# EasyEDA Pro project ProProject_IMUSensorNodes202312.epro, board 6_6_拼板20240123（不带编号） (continued)
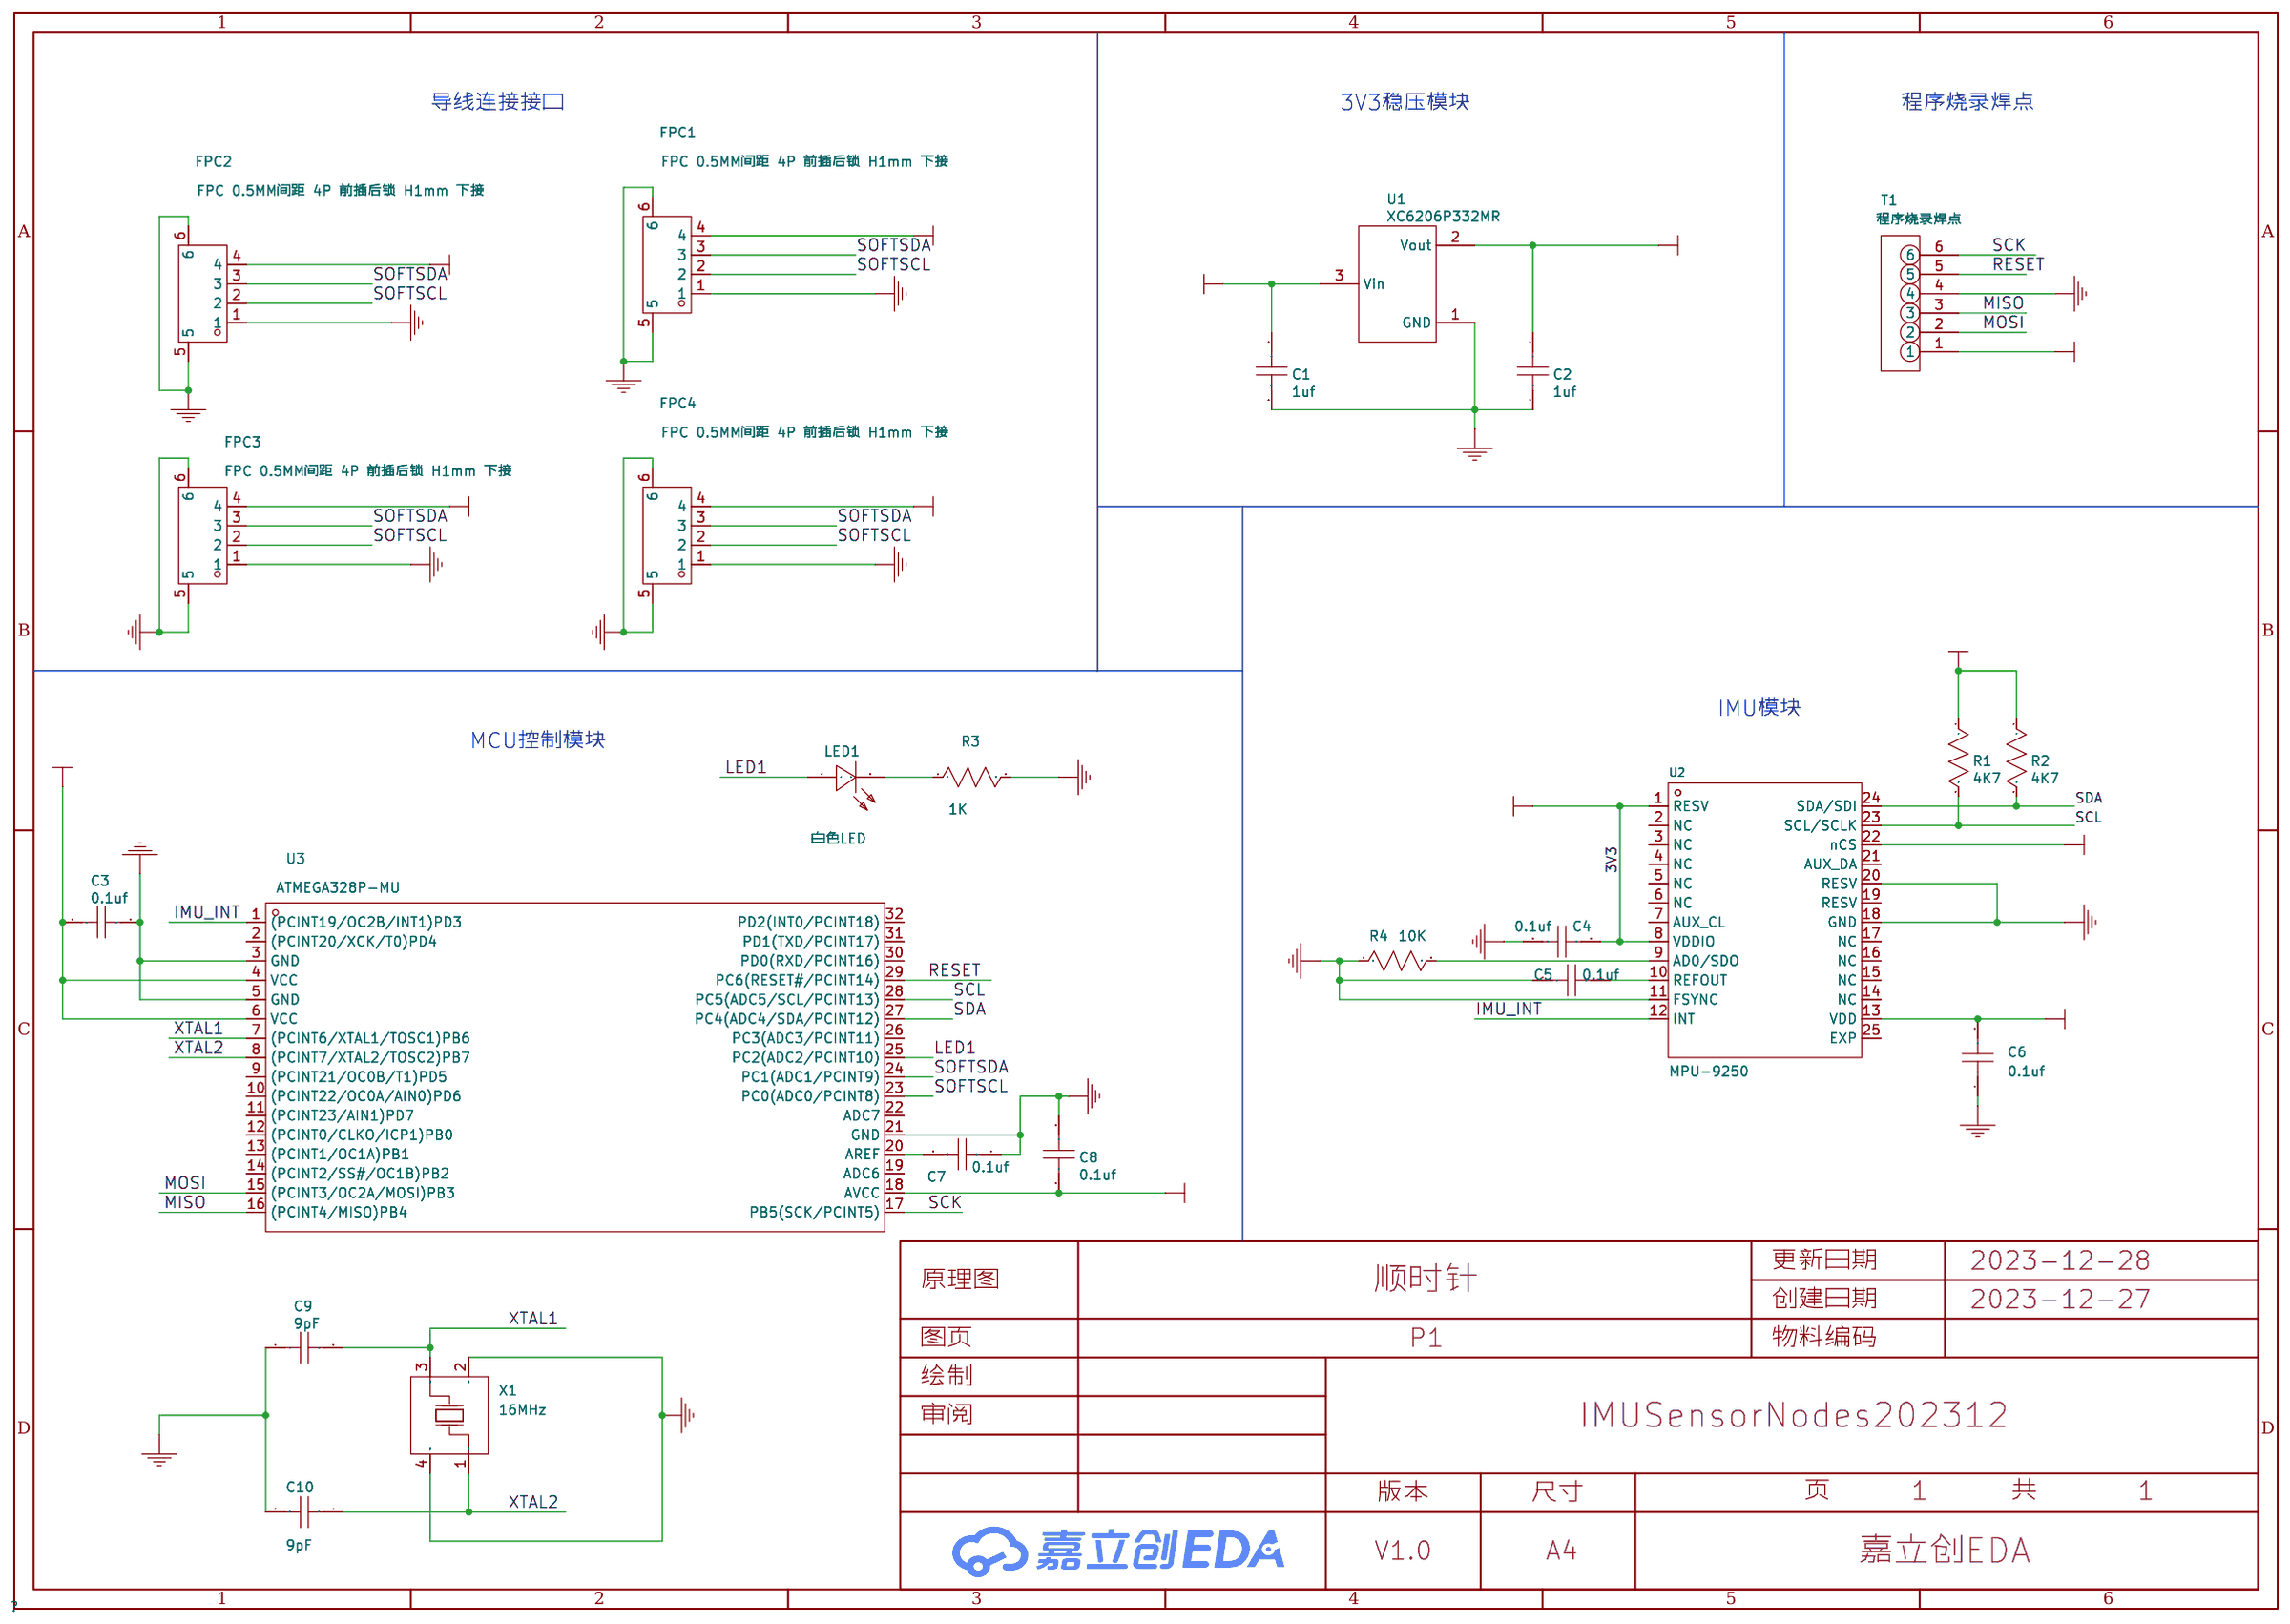
[diagram p0: schematic sheet]
## Routing (per net, layer and track width the routed paths; a pad name or vN(x,y) marks a point on that pad's centre or on a via; arc(x,y) is an arc through that point) (continued)
  Bottom Layer w0.254: v1(75.22,69.75) 74.83,69.37 74.18,69.37 73.92,69.62 U3#83.18 ; 28.31,51.84 28.57,52.1 28.61,52.1 ; 28.31,51.84 28.35,51.84 28.61,52.1 ; 28.31,51.84 v1(28.22,51.84) ; U2#15.8 60.74,78.7 60.74,79.66 ; C4#5.1 48.77,38.85 48.73,38.89 ; C4#5.1 arc(48.92,38.74) 49.28,38.89 ; C4#5.1 arc(48.62,38.74) 48.27,38.89 ; C2#30.1 9.94,46.66 9.94,47.4 ; R2#6.1 70.11,79.63 v1(70.52,80.04) 71.32,80.04 ; 55.91,79.53 R2#20.1 56.14,79.76 ; 55.91,79.53 55.87,79.53 55.62,79.28 ; 55.91,79.53 56.14,79.76 ; 55.91,79.53 55.66,79.28 55.62,79.28 ; 21.98,11.46 23.91,11.46 24.29,11.08 24.29,9.43 23.27,8.41 23.27,5.49 23.4,5.36 23.63,5.36 C2#14.1 ; 21.98,11.46 21.43,11.46 ; 21.98,11.46 arc(21.62,11.31) C4#16.1 ; 6.13,52.23 6.13,51.27 U2#30.8 ; 19.78,52.58 19.78,52.11 arc(19.64,52.46) 19.29,52.61 ; 64.55,19.97 64.55,22.38 65.18,23.02 65.18,24.41 64.42,25.17 62.74,25.17 ; 64.55,19.97 64.87,20.29 65.43,20.29 ; 64.55,19.97 64.55,19.23 C2#11.1 ; 1.3,65.81 1.53,66.04 ; 1.3,65.81 1.26,65.81 1.01,65.56 ; 1.3,65.81 R2#24.1 1.53,66.04 ; 1.3,65.81 1.05,65.56 1.01,65.56 ; 1.53,66.04 1.81,66.32 ; 17.32,52.21 U2#14.1 arc(17.14,52.43) 16.71,52.61 ; 17.32,52.21 17.32,52.61 ; 17.32,52.21 arc(17.44,52.49) 17.72,52.61 ; U2#35.22 71.12,23.34 70.77,22.99 v1(70.77,22.64) 70.8,22.61 C3#12.1 70.8,20.98 73.31,20.98 73.44,20.86 ; U1#35.2 78.36,46.94 C2#35.1 ; 9.94,61.12 9.94,60.38 C2#24.1 ; 9.94,61.12 9.94,63.53 10.57,64.16 10.57,65.56 9.81,66.32 8.13,66.32 ; 9.94,61.12 10.26,61.44 10.82,61.44 ; 17.32,79.64 U2#7.1 arc(17.14,79.86) 16.71,80.04 ; 17.32,79.64 17.32,80.04 ; 17.32,79.64 arc(17.44,79.92) 17.72,80.04 ; 1.3,10.95 R2#13.1 1.53,11.18 ; 1.3,10.95 1.53,11.18 ; 1.3,10.95 1.05,10.7 1.01,10.7 ; 1.3,10.95 1.26,10.95 1.01,10.7 ; U3#85.6 59.72,6.39 v2(59.72,7.33) 59.78,7.4 60.1,7.4 60.21,7.51 U2#23.13 ; R2#31.1 15.5,52.2 v1(15.91,52.61) 16.71,52.61 ; C4#3.1 21.47,38.85 21.43,38.89 ; C4#3.1 arc(21.62,38.74) 21.98,38.89 ; C4#3.1 arc(21.32,38.74) 20.96,38.89 ; 18.83,75.72 18.7,75.85 16.19,75.85 C3#21.1 16.19,77.47 v1(16.16,77.5) 16.16,77.86 16.51,78.21 16.89,78.21 ; 20.04,38.87 20.01,38.89 ; 20.01,38.89 19.29,38.89 ; 20.01,38.89 20.38,38.89 ; C4#12.1 62.24,80.01 62.26,80.04 62.74,80.04 ; C4#12.1 arc(62.09,79.89) 61.73,80.04 61.5,80.04 ; C4#12.1 arc(62.38,79.89) 62.74,80.04 ; C2#16.1 50.93,5.36 50.7,5.36 50.58,5.49 50.58,8.41 51.59,9.43 51.59,11.08 51.21,11.46 49.28,11.46 ; C2#16.1 51.06,4.22 50.68,3.84 v1(49.69,3.84) C8#16.1 ; C2#16.1 51.06,5.79 U1#16.2 ; 37.24,47.4 37.24,46.66 C2#32.1 ; 37.24,47.4 37.56,47.72 38.12,47.72 ; 37.24,47.4 37.24,49.81 37.88,50.45 37.88,51.84 37.12,52.61 35.44,52.61 ; v1(28.22,65.56) 28.31,65.56 ; 28.31,65.56 28.35,65.56 28.61,65.81 ; 28.31,65.56 28.57,65.81 28.61,65.81 ; C8#29.1 v1(76.99,58.7) 77.98,58.7 78.36,59.08 C2#29.1 ; 9.94,33.68 9.94,32.95 C2#36.1 ; 9.94,33.68 10.26,34 10.82,34 ; 9.94,33.68 9.94,36.1 10.57,36.73 10.57,38.13 9.81,38.89 8.13,38.89 ; C8#12.1 v1(76.99,17.56) 77.98,17.56 78.36,17.94 C2#12.1 ; 65.43,6.57 64.87,6.57 64.55,6.25 ; 65.43,75.15 64.87,75.15 64.55,74.83 ; C4#30.1 76.08,66.28 76.04,66.32 ; C4#30.1 arc(75.93,66.17) 75.57,66.32 ; C4#30.1 arc(76.23,66.17) 76.59,66.32 ; 16.71,80.04 17.72,80.04 ; 16.71,80.04 v1(15.91,80.04) 15.5,79.63 R2#21.1 ; 17.72,80.04 19.29,80.04 ; 48.27,38.89 48.73,38.89 ; 48.27,38.89 47.69,38.89 ; 48.73,38.89 49.28,38.89 ; 76.04,66.32 76.59,66.32 ; 76.04,66.32 75.57,66.32 ; 47.69,38.89 47.32,38.89 ; 47.69,38.89 arc(47.26,38.71) 47.09,38.29 ; 37.24,74.83 37.56,75.15 38.12,75.15 ; 37.24,74.83 37.24,77.25 37.88,77.88 37.88,79.28 37.12,80.04 35.44,80.04 ; 37.24,74.83 37.24,74.09 C2#22.1 ; 21.43,38.89 21.98,38.89 ; 21.43,38.89 20.96,38.89 ; 21.98,38.89 23.91,38.89 24.29,38.51 24.29,36.86 23.27,35.84 23.27,32.92 23.4,32.8 23.63,32.8 C2.1 ; 65.43,47.72 64.87,47.72 64.55,47.4 ; 75.57,25.17 76.04,25.17 ; 75.57,25.17 74.99,25.17 ; 75.57,25.17 arc(75.93,25.03) C4.1 ; 76.04,25.17 76.08,25.14 C4.1 ; 76.04,25.17 76.59,25.17 ; R1#2.1 28.45,36.86 v1(28.35,36.86) ; v1(75.22,56.04) 74.83,55.66 74.18,55.66 73.92,55.91 U3#61.18 ; 55.62,38.13 55.87,38.38 55.91,38.38 ; 55.62,38.13 v1(55.53,38.13) ; 55.62,38.13 55.66,38.13 55.91,38.38 ; 71.93,11.06 U2#20.1 arc(71.75,11.28) 71.32,11.46 ; 71.93,11.06 71.93,11.46 ; 71.93,11.06 arc(72.05,11.34) 72.32,11.46 ; v1(14.94,64.29) 14.94,64.34 15.27,64.67 R1#25.1 ; C8#10.1 v1(49.69,17.56) 50.68,17.56 51.06,17.94 C2#10.1 ; 46.13,7.14 46,7.27 43.49,7.27 C3#16.1 43.49,8.89 v1(43.47,8.92) 43.47,9.28 43.82,9.63 U2#19.22 ; 18.83,48.29 18.7,48.42 16.19,48.42 C3#31.1 16.19,50.04 v1(16.16,50.07) 16.16,50.42 16.51,50.78 U2#14.22 ; 48.27,25.17 47.69,25.17 ; 48.27,25.17 48.73,25.17 ; 48.27,25.17 arc(48.62,25.03) C4#13.1 ; 47.69,25.17 47.32,25.17 ; 47.69,25.17 arc(47.26,25) 47.09,24.57 ; 76.59,52.61 78.52,52.61 78.9,52.23 78.9,50.58 77.88,49.56 77.88,46.64 78.01,46.51 78.24,46.51 C2#35.1 ; 76.59,52.61 76.04,52.61 ; 76.59,52.61 arc(76.23,52.46) C4#36.1 ; 48.27,66.32 47.69,66.32 ; 48.27,66.32 48.73,66.32 ; 48.27,66.32 arc(48.62,66.17) C4#28.1 ; 47.69,66.32 47.32,66.32 ; 47.69,66.32 arc(47.26,66.15) 47.09,65.72 ; 72.32,52.61 73.9,52.61 ; 72.32,52.61 71.32,52.61 ; 72.32,52.61 arc(72.05,52.49) 71.93,52.21 ; 73.9,52.61 74.62,52.61 ; 73.9,52.61 arc(74.25,52.46) 74.39,52.11 74.39,52.58 ; 76.59,66.32 78.52,66.32 78.9,65.94 78.9,64.29 77.88,63.28 77.88,60.35 78.01,60.23 78.24,60.23 C2#29.1 ; 20.04,80.02 20.01,80.04 ; 20.01,80.04 20.38,80.04 ; 20.01,80.04 19.29,80.04 ; 17.32,38.5 17.32,38.89 ; 17.32,38.5 U2#28.1 arc(17.14,38.71) 16.71,38.89 ; 17.32,38.5 arc(17.44,38.78) 17.72,38.89 ; C2#10.1 51.06,19.51 U1#10.2 ; C2#10.1 50.93,19.08 50.7,19.08 50.58,19.21 50.58,22.13 51.59,23.14 51.59,24.79 51.21,25.17 49.28,25.17 ; 47.32,11.46 47.69,11.46 ; 47.32,11.46 46.59,11.46 ; 47.32,11.46 47.34,11.44 ; 47.69,11.46 48.27,11.46 ; 47.69,11.46 arc(47.26,11.28) 47.09,10.86 ; 21.98,52.61 23.91,52.61 24.29,52.23 24.29,50.58 23.27,49.56 23.27,46.64 23.4,46.51 23.63,46.51 C2#31.1 ; 21.98,52.61 21.43,52.61 ; 21.98,52.61 arc(21.62,52.46) C4#32.1 ; 28.83,11.18 29.11,11.46 ; 28.83,11.18 28.61,10.95 ; 28.83,11.18 R2#15.1 28.61,10.95 ; U3#95.18 19.31,14.76 19.57,14.51 20.22,14.51 v1(20.6,14.89) ; 28.61,65.81 28.83,66.04 ; 28.61,65.81 R2#26.1 28.83,66.04 ; 28.83,66.04 29.11,66.32 ; C2#6.1 78.24,73.94 78.01,73.94 77.88,74.07 77.88,76.99 78.9,78.01 78.9,79.66 78.52,80.04 76.59,80.04 ; C2#6.1 78.36,74.37 U1#6.2 ; C2#6.1 78.36,72.8 77.98,72.42 v1(76.99,72.42) C8#6.1 ; v1(55.53,10.7) 55.62,10.7 ; 55.62,10.7 55.66,10.7 55.91,10.95 ; 55.62,10.7 55.87,10.95 55.91,10.95 ; 33.43,79.66 33.43,78.7 U2#27.8 ; C2#21.1 23.75,74.37 U1#21.2 ; C2#21.1 23.63,73.94 23.4,73.94 23.27,74.07 23.27,76.99 24.29,78.01 24.29,79.66 23.91,80.04 21.98,80.04 ; C2#21.1 23.75,72.8 23.37,72.42 v1(22.38,72.42) C8#21.1 ; 1.01,51.84 1.26,52.1 1.3,52.1 ; 1.01,51.84 1.05,51.84 1.3,52.1 ; 1.01,51.84 v1(0.92,51.84) ; R1#24.1 1.15,64.29 v1(1.05,64.29) ; 71.93,52.21 U2#6.1 arc(71.75,52.43) 71.32,52.61 ; 71.93,52.21 71.93,52.61 ; 74.99,25.17 74.62,25.17 ; 74.99,25.17 arc(74.57,25) 74.39,24.57 ; 48.27,11.46 48.73,11.46 ; 48.27,11.46 arc(48.62,11.31) C4#18.1 ; 48.73,11.46 48.77,11.42 C4#18.1 ; 48.73,11.46 49.28,11.46 ; v1(14.94,23.14) 14.94,23.19 15.27,23.52 R1#8.1 ; 28.31,10.7 28.35,10.7 28.61,10.95 ; 28.31,10.7 28.57,10.95 28.61,10.95 ; 28.31,10.7 v1(28.22,10.7) ; 8.13,66.32 7.65,66.32 7.63,66.3 C4#25.1 ; 8.13,66.32 arc(7.77,66.17) C4#25.1 ; 44.02,66.32 v1(43.21,66.32) 42.8,65.92 R2#27.1 ; 44.02,66.32 45.02,66.32 ; 44.02,66.32 arc(44.45,66.15) U2#34.1 44.62,65.93 ; v1(14.94,36.86) 14.94,36.91 15.27,37.24 R1.1 ; 75.57,66.32 74.99,66.32 ; 28.61,79.53 28.57,79.53 28.31,79.28 ; 28.61,79.53 28.35,79.28 28.31,79.28 ; 28.61,79.53 28.83,79.76 ; 28.61,79.53 R2#22.1 28.83,79.76 ; U1#8.2 23.75,19.51 C2#8.1 ; 28.61,38.38 R2#2.1 28.83,38.61 ; 28.61,38.38 28.35,38.13 28.31,38.13 ; 28.61,38.38 28.57,38.38 28.31,38.13 ; 28.61,38.38 28.83,38.61 ; C2#5.1 78.36,31.65 77.98,31.27 v1(76.99,31.27) C8#5.1 ; C2#5.1 78.24,32.8 78.01,32.8 77.88,32.92 77.88,35.84 78.9,36.86 78.9,38.51 78.52,38.89 76.59,38.89 ; C2#5.1 78.36,33.22 U1#5.2 ; 72.32,66.32 73.9,66.32 ; 72.32,66.32 71.32,66.32 ; 72.32,66.32 arc(72.05,66.21) 71.93,65.93 ; 73.9,66.32 74.62,66.32 ; 73.9,66.32 arc(74.25,66.18) 74.39,65.83 74.39,66.3 ; C2#33.1 51.06,45.37 50.68,44.99 v1(49.69,44.99) C8#33.1 ; C2#33.1 51.06,46.94 U1#33.2 ; C2#33.1 50.93,46.51 50.7,46.51 50.58,46.64 50.58,49.56 51.59,50.58 51.59,52.23 51.21,52.61 49.28,52.61 ; v1(55.53,65.56) 55.62,65.56 ; 55.62,65.56 55.87,65.81 55.91,65.81 ; 55.62,65.56 55.66,65.56 55.91,65.81 ; 55.91,24.67 R2#11.1 56.14,24.9 ; 55.91,24.67 55.66,24.41 55.62,24.41 ; 55.91,24.67 55.87,24.67 55.62,24.41 ; 55.91,24.67 56.14,24.9 ; 55.91,10.95 R2#17.1 56.14,11.18 ; 55.91,10.95 56.14,11.18 ; C2#15.1 37.24,5.51 37.24,6.25 ; 75.57,80.04 76.04,80.04 ; 75.57,80.04 74.99,80.04 ; 75.57,80.04 arc(75.93,79.89) C4#8.1 ; 76.04,80.04 76.08,80 C4#8.1 ; 76.04,80.04 76.59,80.04 ; C8#31.1 v1(22.38,44.99) 23.37,44.99 23.75,45.37 C2#31.1 ; U2#28.22 16.51,37.06 16.16,36.71 v1(16.16,36.35) 16.19,36.33 C3.1 16.19,34.7 18.7,34.7 18.83,34.57 ; 1.01,24.41 1.26,24.67 1.3,24.67 ; 1.01,24.41 1.05,24.41 1.3,24.67 ; 1.01,24.41 v1(0.92,24.41) ; 46.13,48.29 46,48.42 43.49,48.42 C3#33.1 43.49,50.04 v1(43.47,50.07) 43.47,50.42 43.82,50.78 U2#5.22 ; 34.19,66.32 34.42,66.32 arc(34.78,66.17) C4#27.1 ; U3#66.6 59.72,74.97 v2(59.72,75.91) 59.78,75.97 60.1,75.97 60.21,76.09 U2#15.13 ; 8.13,52.61 7.65,52.61 7.63,52.58 C4#31.1 ; 8.13,52.61 9.81,52.61 10.57,51.84 10.57,50.45 9.94,49.81 9.94,47.4 ; 8.13,52.61 arc(7.77,52.46) C4#31.1 ; 47.09,52.58 47.09,52.11 arc(46.94,52.46) 46.59,52.61 ; 76.59,38.89 76.04,38.89 ; 76.59,38.89 arc(76.23,38.74) C4#7.1 ; 18.83,20.86 18.7,20.98 16.19,20.98 C3#8.1 16.19,22.61 v1(16.16,22.64) 16.16,22.99 16.51,23.34 U2#22.22 ; 76.04,38.89 76.08,38.85 C4#7.1 ; 76.04,38.89 75.57,38.89 ; C2#23.1 50.93,73.94 50.7,73.94 50.58,74.07 50.58,76.99 51.59,78.01 51.59,79.66 51.21,80.04 49.28,80.04 ; C2#23.1 51.06,72.8 50.68,72.42 v1(49.69,72.42) C8#23.1 ; C2#23.1 51.06,74.37 U1#23.2 ; 28.31,79.28 v1(28.22,79.28) ; C2.1 23.75,31.65 23.37,31.27 v1(22.38,31.27) C8.1 ; C2.1 23.75,33.22 U1.2 ; 61.5,25.17 61.73,25.17 arc(62.09,25.03) C4#14.1 ; 76.04,52.61 76.08,52.57 C4#36.1 ; 76.04,52.61 75.57,52.61 ; v1(1.05,23.14) 1.15,23.14 R1#7.1 ; 61.5,66.32 61.73,66.32 arc(62.09,66.17) C4#29.1 ; 28.83,24.9 29.11,25.17 ; 28.83,24.9 R2#9.1 28.61,24.67 ; 28.83,24.9 28.61,24.67 ; C8#25.1 v1(22.38,58.7) 23.37,58.7 23.75,59.08 C2#25.1 ; 21.43,25.17 21.98,25.17 ; 21.43,25.17 21.47,25.14 C4#10.1 ; 21.43,25.17 20.96,25.17 ; 21.98,25.17 23.91,25.17 24.29,24.79 24.29,23.14 23.27,22.13 23.27,19.21 23.4,19.08 23.63,19.08 C2#8.1 ; 21.98,25.17 arc(21.62,25.03) C4#10.1 ; 56.14,79.76 56.42,80.04 ; 64.55,33.68 64.87,34 65.43,34 ; 64.55,33.68 64.55,36.1 65.18,36.73 65.18,38.13 64.42,38.89 62.74,38.89 ; 64.55,33.68 64.55,32.95 C2#4.1 ; 21.43,80.04 21.47,80 C4#22.1 ; 21.43,80.04 21.98,80.04 ; 21.43,80.04 20.96,80.04 ; 9.94,6.25 9.94,5.51 C2#13.1 ; 9.94,6.25 10.26,6.57 10.82,6.57 ; 9.94,6.25 9.94,8.66 10.57,9.3 10.57,10.7 9.81,11.46 8.13,11.46 ; C8#14.1 v1(22.38,3.84) 23.37,3.84 23.75,4.22 C2#14.1 ; 74.39,38.87 74.39,38.4 arc(74.25,38.75) 73.9,38.89 ; R2#23.1 42.8,79.63 v1(43.21,80.04) 44.02,80.04 ; C2#29.1 78.36,60.66 U1#29.2 ; C2#18.1 78.24,5.36 78.01,5.36 77.88,5.49 77.88,8.41 78.9,9.43 78.9,11.08 78.52,11.46 76.59,11.46 ; C2#18.1 78.36,4.22 77.98,3.84 v1(76.99,3.84) C8#18.1 ; C2#18.1 78.36,5.79 U1#18.2 ; C2#28.1 64.55,60.38 64.55,61.12 ; v1(69.55,50.58) 69.55,50.63 69.88,50.96 R1#35.1 ; C4#13.1 48.77,25.14 48.73,25.17 ; C4#13.1 arc(48.92,25.03) 49.28,25.17 ; 47.32,80.04 47.69,80.04 ; 47.32,80.04 46.59,80.04 ; 47.32,80.04 47.34,80.02 ; 47.69,80.04 48.27,80.04 ; 47.69,80.04 arc(47.26,79.86) 47.09,79.44 ; C4#21.1 7.63,80.01 7.65,80.04 8.13,80.04 ; C4#21.1 arc(7.48,79.89) 7.12,80.04 6.89,80.04 ; C4#21.1 arc(7.77,79.89) 8.13,80.04 ; 74.62,66.32 74.99,66.32 ; 74.62,66.32 74.65,66.3 ; 74.99,66.32 arc(74.57,66.15) 74.39,65.72 ; C8#35.1 v1(76.99,44.99) 77.98,44.99 78.36,45.37 C2#35.1 ; 75.57,52.61 74.99,52.61 ; 75.57,52.61 arc(75.93,52.46) C4#36.1 ; v1(28.35,50.58) 28.45,50.58 R1#32.1 ; 61.5,38.89 61.73,38.89 arc(62.09,38.74) C4#6.1 ; v1(28.22,38.13) 28.31,38.13 ; 71.32,66.32 v1(70.52,66.32) 70.11,65.92 R2#29.1 ; 71.32,66.32 arc(71.75,66.15) U2#32.1 71.93,65.93 ; 34.19,80.04 34.42,80.04 arc(34.78,79.89) C4#23.1 ; 44.62,52.21 44.62,52.61 ; 44.62,52.21 U2#5.1 arc(44.45,52.43) 44.02,52.61 ; 44.62,52.21 arc(44.74,52.49) 45.02,52.61 ; C4#26.1 21.47,66.28 21.43,66.32 ; C4#26.1 arc(21.62,66.17) 21.98,66.32 ; C4#26.1 arc(21.32,66.17) 20.96,66.32 ; 9.94,19.97 10.26,20.29 10.82,20.29 ; 9.94,19.97 9.94,22.38 10.57,23.02 10.57,24.41 9.81,25.17 8.13,25.17 ; 9.94,19.97 9.94,19.23 C2#7.1 ; 37.24,6.25 37.56,6.57 38.12,6.57 ; 37.24,6.25 37.24,8.66 37.88,9.3 37.88,10.7 37.12,11.46 35.44,11.46 ; C2#2.1 37.24,32.95 37.24,33.68 ; 62.74,25.17 62.26,25.17 62.24,25.15 C4#14.1 ; 62.74,25.17 arc(62.38,25.03) C4#14.1 ; U3#82.6 59.72,33.82 v2(59.72,34.76) 59.78,34.83 60.1,34.83 60.21,34.94 U2#10.13 ; 64.55,74.83 64.55,77.25 65.18,77.88 65.18,79.28 64.42,80.04 62.74,80.04 ; 64.55,74.83 64.55,74.09 C2#20.1 ; U2#27.13 32.91,76.09 32.8,75.97 32.48,75.97 v2(32.42,75.91) 32.42,74.97 U3#77.6 ; 60.74,11.08 60.74,10.12 U2#23.8 ; 76.04,11.46 76.08,11.42 C4#20.1 ; 76.04,11.46 76.59,11.46 ; 76.04,11.46 75.57,11.46 ; v1(14.94,50.58) 14.94,50.63 15.27,50.96 R1#31.1 ; R1#33.1 42.58,50.96 42.25,50.63 v1(42.25,50.58) ; 46.59,52.61 47.32,52.61 ; 46.59,52.61 45.02,52.61 ; 47.32,52.61 47.69,52.61 ; 47.32,52.61 47.34,52.58 ; C2#26.1 37.24,60.38 37.24,61.12 ; U3#62.18 46.62,14.76 46.87,14.51 47.53,14.51 v1(47.91,14.89) ; C4#15.1 7.63,11.43 7.65,11.46 8.13,11.46 ; C4#15.1 arc(7.77,11.31) 8.13,11.46 ; C4#15.1 arc(7.48,11.31) 7.12,11.46 6.89,11.46 ; v1(55.53,24.41) 55.62,24.41 ; 20.38,80.04 20.96,80.04 ; 20.38,80.04 arc(19.96,79.86) 19.78,79.44 ; 60.74,24.79 60.74,23.84 U2#17.8 ; 21.43,52.61 21.47,52.57 C4#32.1 ; 21.43,52.61 20.96,52.61 ; R1#18.1 69.88,9.81 69.55,9.48 v1(69.55,9.43) ; R1#13.1 1.15,9.43 v1(1.05,9.43) ; 1.53,24.9 R2#7.1 1.3,24.67 ; 1.53,24.9 1.81,25.17 ; 1.53,24.9 1.3,24.67 ; 1.01,10.7 v1(0.92,10.7) ; 19.29,11.46 20.01,11.46 ; 19.29,11.46 17.72,11.46 ; 19.29,11.46 arc(19.64,11.31) 19.78,10.97 19.78,11.44 ; 20.01,11.46 20.04,11.44 ; 20.01,11.46 20.38,11.46 ; 55.62,51.84 55.66,51.84 55.91,52.1 ; 55.62,51.84 v1(55.53,51.84) ; 55.62,51.84 55.87,52.1 55.91,52.1 ; 47.69,52.61 48.27,52.61 ; 47.69,52.61 arc(47.26,52.43) 47.09,52 ; 38.12,61.44 37.56,61.44 37.24,61.12 ; v1(69.55,78.01) 69.55,78.06 69.88,78.39 R1#6.1 ; 73.9,80.04 74.62,80.04 ; 73.9,80.04 72.32,80.04 ; 73.9,80.04 arc(74.25,79.89) 74.39,79.55 74.39,80.02 ; 74.62,80.04 74.99,80.04 ; 74.62,80.04 74.65,80.02 ; 44.62,24.78 U2#2.1 arc(44.45,25) 44.02,25.17 ; 44.62,24.78 44.62,25.17 ; 44.62,24.78 arc(44.74,25.06) 45.02,25.17 ; C4#33.1 34.93,52.58 34.96,52.61 35.44,52.61 ; C4#33.1 arc(35.08,52.46) 35.44,52.61 ; C4#33.1 arc(34.78,52.46) 34.42,52.61 34.19,52.61 ; 1.53,38.61 1.81,38.89 ; 1.53,38.61 1.3,38.38 ; 1.53,38.61 R2#36.1 1.3,38.38 ; 21.98,66.32 23.91,66.32 24.29,65.94 24.29,64.29 23.27,63.28 23.27,60.35 23.4,60.23 23.63,60.23 C2#25.1 ; 21.98,66.32 21.43,66.32 ; R1#10.1 42.58,23.52 42.25,23.19 v1(42.25,23.14) ; U2#29.13 5.6,62.37 5.49,62.26 5.17,62.26 v2(5.11,62.2) 5.11,61.25 U3#74.6 ; 44.02,25.17 v1(43.21,25.17) 42.8,24.77 R2#10.1 ; 44.02,25.17 45.02,25.17 ; U2#30.13 5.6,48.65 5.49,48.54 5.17,48.54 v2(5.11,48.48) 5.11,47.53 U3#68.6 ; C2#12.1 78.36,19.51 U1#12.2 ; C2#12.1 78.24,19.08 78.01,19.08 77.88,19.21 77.88,22.13 78.9,23.14 78.9,24.79 78.52,25.17 76.59,25.17 ; 17.32,65.93 U2#12.1 arc(17.14,66.15) 16.71,66.32 ; 17.32,65.93 17.32,66.32 ; 17.32,65.93 arc(17.44,66.21) 17.72,66.32 ; 1.3,52.1 R2#30.1 1.53,52.33 ; 1.3,52.1 1.53,52.33 ; 62.74,66.32 62.26,66.32 62.24,66.3 C4#29.1 ; 62.74,66.32 64.42,66.32 65.18,65.56 65.18,64.16 64.55,63.53 64.55,61.12 ; 62.74,66.32 arc(62.38,66.17) C4#29.1 ; 74.65,52.58 74.62,52.61 ; 74.62,52.61 74.99,52.61 ; C8#27.1 v1(49.69,58.7) 50.68,58.7 51.06,59.08 C2#27.1 ; 44.02,11.46 45.02,11.46 ; 44.02,11.46 v1(43.21,11.46) 42.8,11.05 R2#16.1 ; 44.02,11.46 arc(44.45,11.28) U2#19.1 44.62,11.06 ; 45.02,11.46 46.59,11.46 ; 45.02,11.46 arc(44.74,11.34) 44.62,11.06 ; U3#75.6 32.42,47.53 v2(32.42,48.48) 32.48,48.54 32.8,48.54 32.91,48.65 U2#21.13 ; 8.13,38.89 7.65,38.89 7.63,38.87 C4#2.1 ; 8.13,38.89 arc(7.77,38.74) C4#2.1 ; 64.55,47.4 64.55,46.66 C2#34.1 ; 64.55,47.4 64.55,49.81 65.18,50.45 65.18,51.84 64.42,52.61 62.74,52.61 ; R1#4.1 55.76,36.86 v1(55.66,36.86) ; 1.53,11.18 1.81,11.46 ; v1(28.35,9.43) 28.45,9.43 R1#15.1 ; 21.43,66.32 20.96,66.32 ; 6.89,52.61 7.12,52.61 arc(7.48,52.46) C4#31.1 ; 75.57,11.46 74.99,11.46 ; 75.57,11.46 arc(75.93,11.31) C4#20.1 ; 74.99,11.46 74.62,11.46 ; 74.99,11.46 arc(74.57,11.28) 74.39,10.86 ; C4#32.1 arc(21.32,52.46) 20.96,52.61 ; 62.74,52.61 62.26,52.61 62.24,52.58 C4#35.1 ; 62.74,52.61 arc(62.38,52.46) C4#35.1 ; U3#92.6 32.42,6.39 v2(32.42,7.33) 32.48,7.4 32.8,7.4 32.91,7.51 U2#25.13 ; 28.83,79.76 29.11,80.04 ; 56.14,52.33 R2#34.1 55.91,52.1 ; 56.14,52.33 56.42,52.61 ; 56.14,52.33 55.91,52.1 ; 17.32,11.06 U2#18.1 arc(17.14,11.28) 16.71,11.46 ; 17.32,11.06 17.32,11.46 ; 17.32,11.06 arc(17.44,11.34) 17.72,11.46 ; 71.93,65.93 71.93,66.32 ; 74.39,25.15 74.39,24.68 arc(74.25,25.03) 73.9,25.17 ; 17.32,24.78 U2#22.1 arc(17.14,25) 16.71,25.17 ; 17.32,24.78 17.32,25.17 ; 17.32,24.78 arc(17.44,25.06) 17.72,25.17 ; 1.01,79.28 1.26,79.53 1.3,79.53 ; 1.01,79.28 v1(0.92,79.28) ; 1.01,79.28 1.05,79.28 1.3,79.53 ; 37.24,61.12 37.24,63.53 37.88,64.16 37.88,65.56 37.12,66.32 35.44,66.32 ; 1.01,65.56 v1(0.92,65.56) ; C2#25.1 23.75,60.66 U1#25.2 ; 74.99,80.04 arc(74.57,79.86) 74.39,79.44 ; 44.02,80.04 45.02,80.04 ; 44.02,80.04 arc(44.45,79.86) U2#24.1 44.62,79.64 ; 45.02,80.04 46.59,80.04 ; 45.02,80.04 arc(44.74,79.92) 44.62,79.64 ; 44.62,38.5 U2#3.1 arc(44.45,38.71) 44.02,38.89 ; 44.62,38.5 44.62,38.89 ; 44.62,38.5 arc(44.74,38.78) 45.02,38.89 ; v1(14.94,9.43) 14.94,9.48 15.27,9.81 R1#14.1 ; U2#20.22 71.12,9.63 70.77,9.28 v1(70.77,8.92) 70.8,8.89 C3#18.1 70.8,7.27 73.31,7.27 73.44,7.14 ; 44.62,65.93 44.62,66.32 ; 44.62,65.93 arc(44.74,66.21) 45.02,66.32 ; 16.71,38.89 17.72,38.89 ; 16.71,38.89 v1(15.91,38.89) 15.5,38.48 R2.1 ; 17.72,38.89 19.29,38.89 ; R1#36.1 1.15,36.86 v1(1.05,36.86) ; R2#12.1 70.11,24.77 v1(70.52,25.17) 71.32,25.17 ; C2#3.1 50.93,32.8 50.7,32.8 50.58,32.92 50.58,35.84 51.59,36.86 51.59,38.51 51.21,38.89 49.28,38.89 ; C2#3.1 51.06,31.65 50.68,31.27 v1(49.69,31.27) C8#3.1 ; C2#3.1 51.06,33.22 U1#3.2 ; R2#14.1 15.5,11.05 v1(15.91,11.46) 16.71,11.46 ; 60.74,38.51 60.74,37.56 U2#10.8 ; v1(47.91,56.04) 47.53,55.66 46.87,55.66 46.62,55.91 U3#78.18 ; 74.62,25.17 73.9,25.17 ; 74.62,25.17 74.65,25.15 ; 1.53,79.76 1.81,80.04 ; 1.53,79.76 1.3,79.53 ; 1.53,79.76 R2#19.1 1.3,79.53 ; 47.09,38.87 47.09,38.4 arc(46.94,38.75) 46.59,38.89 ; 37.24,19.97 37.24,19.23 C2#9.1 ; 37.24,19.97 37.24,22.38 37.88,23.02 37.88,24.41 37.12,25.17 35.44,25.17 ; 37.24,19.97 37.56,20.29 38.12,20.29 ; R1#34.1 55.76,50.58 v1(55.66,50.58) ; 76.59,11.46 arc(76.23,11.31) C4#20.1 ; 75.57,38.89 74.99,38.89 ; 75.57,38.89 arc(75.93,38.74) C4#7.1 ; 74.99,38.89 74.62,38.89 ; 74.99,38.89 arc(74.57,38.71) 74.39,38.29 ; C2#27.1 51.06,60.66 U1#27.2 ; C2#27.1 50.93,60.23 50.7,60.23 50.58,60.35 50.58,63.28 51.59,64.29 51.59,65.94 51.21,66.32 49.28,66.32 ; v1(42.25,64.29) 42.25,64.34 42.58,64.67 R1#27.1 ; 1.3,38.38 1.26,38.38 1.01,38.13 ; 1.3,38.38 1.05,38.13 1.01,38.13 ; C2#31.1 23.75,46.94 U1#31.2 ; 28.61,24.67 28.35,24.41 28.31,24.41 ; 28.61,24.67 28.57,24.67 28.31,24.41 ; v1(47.91,1.17) 47.53,0.79 46.87,0.79 46.62,1.04 U3#86.18 ; v1(75.22,1.17) 74.83,0.79 74.18,0.79 73.92,1.04 U3#80.18 ; 34.19,11.46 34.42,11.46 arc(34.78,11.31) C4#17.1 ; 74.99,52.61 arc(74.57,52.43) 74.39,52 ; 49.28,66.32 48.73,66.32 ; 49.28,66.32 arc(48.92,66.17) C4#28.1 ; v1(55.66,78.01) 55.76,78.01 R1#20.1 ; 44.62,79.64 44.62,80.04 ; 20.01,52.61 20.38,52.61 ; 20.01,52.61 20.04,52.58 ; 20.01,52.61 19.29,52.61 ; 20.38,52.61 20.96,52.61 ; 20.38,52.61 arc(19.96,52.43) 19.78,52 ; v1(20.6,56.04) 20.22,55.66 19.57,55.66 19.31,55.91 U3#88.18 ; 46.59,38.89 47.32,38.89 ; 46.59,38.89 45.02,38.89 ; 47.32,38.89 47.34,38.87 ; 9.94,74.83 10.26,75.15 10.82,75.15 ; 9.94,74.83 9.94,77.25 10.57,77.88 10.57,79.28 9.81,80.04 8.13,80.04 ; 9.94,74.83 9.94,74.09 C2#19.1 ; 18.83,7.14 18.7,7.27 16.19,7.27 C3#14.1 16.19,8.89 v1(16.16,8.92) 16.16,9.28 16.51,9.63 U2#18.22 ; U3#84.18 19.31,42.19 19.57,41.94 20.22,41.94 v1(20.6,42.32) ; 20.96,11.46 21.43,11.46 ; 20.96,11.46 20.38,11.46 ; 20.96,11.46 arc(21.32,11.31) C4#16.1 ; 21.43,11.46 21.47,11.42 C4#16.1 ; 47.09,80.02 47.09,79.55 arc(46.94,79.89) 46.59,80.04 ; 46.59,11.46 arc(46.94,11.31) 47.09,10.97 47.09,11.44 ; 48.73,25.17 49.28,25.17 ; 71.93,24.78 U2#35.1 arc(71.75,25) 71.32,25.17 ; 71.93,24.78 71.93,25.17 ; 71.93,24.78 arc(72.05,25.06) 72.32,25.17 ; v1(47.91,28.6) 47.53,28.22 46.87,28.22 46.62,28.48 U3#79.18 ; 6.89,25.17 7.12,25.17 arc(7.48,25.03) C4#9.1 ; R2#18.1 70.11,11.05 v1(70.52,11.46) 71.32,11.46 ; 55.91,65.81 R2#28.1 56.14,66.04 ; 55.91,65.81 56.14,66.04 ; 19.78,80.02 19.78,79.55 arc(19.64,79.89) 19.29,80.04 ; 74.62,11.46 73.9,11.46 ; 74.62,11.46 74.65,11.44 ; 35.44,66.32 34.96,66.32 34.93,66.3 C4#27.1 ; 35.44,66.32 arc(35.08,66.17) C4#27.1 ; U2.8 6.13,78.7 6.13,79.66 ; 62.74,11.46 62.26,11.46 62.24,11.43 C4#19.1 ; 62.74,11.46 64.42,11.46 65.18,10.7 65.18,9.3 64.55,8.66 64.55,6.25 ; 62.74,11.46 arc(62.38,11.31) C4#19.1 ; 6.89,38.89 7.12,38.89 arc(7.48,38.74) C4#2.1 ; 55.62,79.28 v1(55.53,79.28) ; 62.74,38.89 62.26,38.89 62.24,38.87 C4#6.1 ; 62.74,38.89 arc(62.38,38.74) C4#6.1 ; 35.44,25.17 34.96,25.17 34.93,25.15 C4#11.1 ; 35.44,25.17 arc(35.08,25.03) C4#11.1 ; 16.71,66.32 v1(15.91,66.32) 15.5,65.92 R2#25.1 ; 16.71,66.32 17.72,66.32 ; R1#19.1 1.15,78.01 v1(1.05,78.01) ; 71.32,11.46 72.32,11.46 ; 72.32,11.46 73.9,11.46 ; R2#8.1 15.5,24.77 v1(15.91,25.17) 16.71,25.17 ; v1(42.25,36.86) 42.25,36.91 42.58,37.24 R1#3.1 ; 47.34,66.3 47.32,66.32 ; 47.32,66.32 46.59,66.32 ; 61.5,11.46 61.73,11.46 arc(62.09,11.31) C4#19.1 ; v1(28.35,64.29) 28.45,64.29 R1#26.1 ; 10.82,47.72 10.26,47.72 9.94,47.4 ; 35.44,11.46 34.96,11.46 34.93,11.43 C4#17.1 ; 35.44,11.46 arc(35.08,11.31) C4#17.1 ; 76.59,80.04 arc(76.23,79.89) C4#8.1 ; v1(42.25,9.43) 42.25,9.48 42.58,9.81 R1#16.1 ; R1#29.1 69.88,64.67 69.55,64.34 v1(69.55,64.29) ; 71.93,38.5 71.93,38.89 ; 71.93,38.5 U2#16.1 arc(71.75,38.71) 71.32,38.89 ; 71.93,38.5 arc(72.05,38.78) 72.32,38.89 ; 73.9,11.46 arc(74.25,11.31) 74.39,10.97 74.39,11.44 ; 34.19,25.17 34.42,25.17 arc(34.78,25.03) C4#11.1 ; C4#23.1 34.93,80.01 34.96,80.04 35.44,80.04 ; C4#23.1 arc(35.08,79.89) 35.44,80.04 ; U3#71.18 19.31,69.62 19.57,69.37 20.22,69.37 v1(20.6,69.75) ; 18.83,62 18.7,62.13 16.19,62.13 C3#25.1 16.19,63.76 v1(16.16,63.78) 16.16,64.14 16.51,64.49 U2#12.22 ; v1(28.35,78.01) 28.45,78.01 R1#22.1 ; C4#34.1 48.77,52.57 48.73,52.61 ; C4#34.1 arc(48.92,52.46) 49.28,52.61 ; C4#34.1 arc(48.62,52.46) 48.27,52.61 ; 20.38,11.46 arc(19.96,11.28) 19.78,10.86 ; v1(47.91,69.75) 47.53,69.37 46.87,69.37 46.62,69.62 U3#69.18 ; 44.02,52.61 45.02,52.61 ; 44.02,52.61 v1(43.21,52.61) 42.8,52.2 R2#33.1 ; 47.32,25.17 46.59,25.17 ; 47.32,25.17 47.34,25.15 ; 73.44,75.72 73.31,75.85 70.8,75.85 C3#6.1 70.8,77.47 v1(70.77,77.5) 70.77,77.86 71.12,78.21 71.5,78.21 ; v1(69.55,36.86) 69.55,36.91 69.88,37.24 R1#5.1 ; v1(75.22,42.32) 74.83,41.94 74.18,41.94 73.92,42.19 U3#67.18 ; 33.43,38.51 33.43,37.56 U2#8.8 ; 48.73,52.61 49.28,52.61 ; 48.73,52.61 48.27,52.61 ; C4#10.1 arc(21.32,25.03) 20.96,25.17 ; C4#18.1 arc(48.92,11.31) 49.28,11.46 ; 8.13,25.17 7.65,25.17 7.63,25.15 C4#9.1 ; 8.13,25.17 arc(7.77,25.03) C4#9.1 ; U2#2.22 43.82,23.34 43.47,22.99 v1(43.47,22.64) 43.49,22.61 C3#10.1 43.49,20.98 46,20.98 46.13,20.86 ; 28.83,38.61 29.11,38.89 ; 45.02,25.17 46.59,25.17 ; 46.59,25.17 arc(46.94,25.03) 47.09,24.68 47.09,25.15 ; v1(55.66,64.29) 55.76,64.29 R1#28.1 ; 19.29,25.17 20.01,25.17 ; 19.29,25.17 17.72,25.17 ; 19.29,25.17 arc(19.64,25.03) 19.78,24.68 19.78,25.15 ; 20.01,25.17 20.04,25.15 ; 20.01,25.17 20.38,25.17 ; 48.73,66.32 48.77,66.28 C4#28.1 ; 16.71,52.61 17.72,52.61 ; 17.72,52.61 19.29,52.61 ; 1.01,38.13 v1(0.92,38.13) ; U3#81.18 19.31,28.48 19.57,28.22 20.22,28.22 v1(20.6,28.6) ; 71.32,52.61 v1(70.52,52.61) 70.11,52.2 R2#35.1 ; 19.29,38.89 arc(19.64,38.75) 19.78,38.4 19.78,38.87 ; 46.13,62 46,62.13 43.49,62.13 C3#27.1 43.49,63.76 v1(43.47,63.78) 43.47,64.14 43.82,64.49 U2#34.22 ; 74.62,38.89 73.9,38.89 ; 74.62,38.89 74.65,38.87 ; 33.43,52.23 33.43,51.27 U2#21.8 ; 46.59,66.32 45.02,66.32 ; 46.59,66.32 arc(46.94,66.18) 47.09,65.83 47.09,66.3 ; 44.62,11.06 44.62,11.46 ; U2#29.8 6.13,64.99 6.13,65.94 ; R1#11.1 55.76,23.14 v1(55.66,23.14) ; 61.5,52.61 61.73,52.61 arc(62.09,52.46) C4#35.1 ; 49.28,80.04 48.73,80.04 ; 49.28,80.04 arc(48.92,79.89) C4#24.1 ; v1(1.05,50.58) 1.15,50.58 R1#30.1 ; 55.91,38.38 56.14,38.61 ; 55.91,38.38 R2#4.1 56.14,38.61 ; 56.14,38.61 56.42,38.89 ; 16.71,11.46 17.72,11.46 ; U2#13.8 60.74,64.99 60.74,65.94 ; 48.73,80.04 48.77,80 C4#24.1 ; 48.73,80.04 48.27,80.04 ; U2#31.8 33.43,64.99 33.43,65.94 ; U2#6.22 71.12,50.78 70.77,50.42 v1(70.77,50.07) 70.8,50.04 C3#35.1 70.8,48.42 73.31,48.42 73.44,48.29 ; 16.71,25.17 17.72,25.17 ; 73.9,25.17 72.32,25.17 ; U2#17.13 60.21,21.22 60.1,21.11 59.78,21.11 v2(59.72,21.05) 59.72,20.1 U3#93.6 ; U2#9.13 32.91,21.22 32.8,21.11 32.48,21.11 v2(32.42,21.05) 32.42,20.1 U3#73.6 ; 60.74,52.23 60.74,51.27 U2#26.8 ; 71.32,38.89 v1(70.52,38.89) 70.11,38.48 R2#5.1 ; 71.32,38.89 72.32,38.89 ; U3#87.18 73.92,28.48 74.18,28.22 74.83,28.22 v1(75.22,28.6) ; U2#32.22 71.12,64.49 70.77,64.14 v1(70.77,63.78) 70.8,63.76 C3#29.1 70.8,62.13 73.31,62.13 73.44,62 ; U3#63.6 59.72,61.25 v2(59.72,62.2) 59.78,62.26 60.1,62.26 60.21,62.37 U2#13.13 ; 20.01,66.32 20.38,66.32 ; 20.01,66.32 19.29,66.32 ; 20.01,66.32 20.04,66.3 ; 20.38,66.32 20.96,66.32 ; 20.38,66.32 arc(19.96,66.15) 19.78,65.72 ; 73.9,38.89 72.32,38.89 ; R1#9.1 28.45,23.14 v1(28.35,23.14) ; v1(75.22,14.89) 74.83,14.51 74.18,14.51 73.92,14.76 U3#94.18 ; v1(55.66,9.43) 55.76,9.43 R1#17.1 ; 28.61,52.1 28.83,52.33 ; 28.61,52.1 R2#32.1 28.83,52.33 ; C4#24.1 arc(48.62,79.89) 48.27,80.04 ; C4.1 arc(76.23,25.03) 76.59,25.17 ; 33.43,11.08 33.43,10.12 U2#25.8 ; R2#3.1 42.8,38.48 v1(43.21,38.89) 44.02,38.89 ; 56.14,24.9 56.42,25.17 ; 64.55,61.12 64.87,61.44 65.43,61.44 ; U3#65.6 5.11,33.82 v2(5.11,34.76) 5.17,34.83 5.49,34.83 5.6,34.94 U2#4.13 ; 28.83,52.33 29.11,52.61 ; 64.55,6.25 64.55,5.51 C2#17.1 ; 28.31,24.41 v1(28.22,24.41) ; U2#9.8 33.43,23.84 33.43,24.79 ; 21.98,80.04 arc(21.62,79.89) C4#22.1 ; 46.13,34.57 46,34.7 43.49,34.7 C3#3.1 43.49,36.33 v1(43.47,36.35) 43.47,36.71 43.82,37.06 U2#3.22 ; R1#12.1 69.88,23.52 69.55,23.19 v1(69.55,23.14) ; 1.53,52.33 1.81,52.61 ; C4#22.1 arc(21.32,79.89) 20.96,80.04 ; U2#16.22 71.12,37.06 70.77,36.71 v1(70.77,36.35) 70.8,36.33 C3#5.1 70.8,34.7 73.31,34.7 73.44,34.57 ; U3#96.6 5.11,74.97 v2(5.11,75.91) 5.17,75.97 5.49,75.97 5.6,76.09 U2.13 ; 56.14,11.18 56.42,11.46 ; 45.02,38.89 44.02,38.89 ; U3#70.6 32.42,33.82 v2(32.42,34.76) 32.48,34.83 32.8,34.83 32.91,34.94 U2#8.13 ; 17.72,66.32 19.29,66.32 ; R1#23.1 42.58,78.39 42.25,78.06 v1(42.25,78.01) ; v1(14.94,78.01) 14.94,78.06 15.27,78.39 R1#21.1 ; 37.24,33.68 37.56,34 38.12,34 ; 37.24,33.68 37.24,36.1 37.88,36.73 37.88,38.13 37.12,38.89 35.44,38.89 ; v1(20.6,1.17) 20.22,0.79 19.57,0.79 19.31,1.04 U3#90.18 ; 19.29,66.32 arc(19.64,66.18) 19.78,65.83 19.78,66.3 ; v1(47.91,42.32) 47.53,41.94 46.87,41.94 46.62,42.19 U3#64.18 ; C2#8.1 23.75,17.94 23.37,17.56 v1(22.38,17.56) C8#8.1 ; C2#14.1 23.75,5.79 U1#14.2 ; 71.32,25.17 72.32,25.17 ; U3#89.6 59.72,47.53 v2(59.72,48.48) 59.78,48.54 60.1,48.54 60.21,48.65 U2#26.13 ; U3#91.6 5.11,6.39 v2(5.11,7.33) 5.17,7.4 5.49,7.4 5.6,7.51 U2#11.13 ; 20.96,25.17 20.38,25.17 ; 35.44,38.89 34.96,38.89 34.93,38.87 C4#4.1 ; 35.44,38.89 arc(35.08,38.74) C4#4.1 ; U2#31.13 32.91,62.37 32.8,62.26 32.48,62.26 v2(32.42,62.2) 32.42,61.25 U3#76.6 ; U2#4.8 6.13,37.56 6.13,38.51 ; 20.38,25.17 arc(19.96,25) 19.78,24.57 ; U2#11.8 6.13,10.12 6.13,11.08 ; U2#33.13 5.6,21.22 5.49,21.11 5.17,21.11 v2(5.11,21.05) 5.11,20.1 U3#72.6 ; 6.89,66.32 7.12,66.32 arc(7.48,66.17) C4#25.1 ; 71.93,79.64 U2#36.1 arc(71.75,79.86) 71.32,80.04 ; 71.93,79.64 71.93,80.04 ; 71.93,79.64 arc(72.05,79.92) 72.32,80.04 ; 34.19,38.89 34.42,38.89 arc(34.78,38.74) C4#4.1 ; 46.13,75.72 46,75.85 43.49,75.85 C3#23.1 43.49,77.47 v1(43.47,77.5) 43.47,77.86 43.82,78.21 44.2,78.21 ; 71.32,80.04 72.32,80.04 ; 20.96,38.89 20.38,38.89 ; U2#33.8 6.13,23.84 6.13,24.79 ; 56.14,66.04 56.42,66.32 ; 20.38,38.89 arc(19.96,38.71) 19.78,38.29
  vias: v1(6.67,69.67) v1(6.67,55.96) v1(6.67,42.24) v1(6.67,28.53) v1(6.67,14.81) v1(6.67,1.09) v1(8.48,71.91) v1(8.48,58.19) v1(8.48,44.48) v1(8.48,30.76) v1(8.48,17.05) v1(8.48,3.33) v1(33.98,69.67) v1(33.98,55.96) v1(33.98,42.24) v1(33.98,28.53) v1(33.98,14.81) v1(33.98,1.09) v1(35.79,71.91) v1(35.79,58.19) v1(35.79,44.48) v1(35.79,30.76) v1(35.79,17.05) v1(35.79,3.33) v1(61.28,69.67) v1(61.28,55.96) v1(61.28,42.24) v1(61.28,28.53) v1(61.28,14.81) v1(61.28,1.09) v1(63.09,71.91) v1(63.09,58.19) v1(63.09,44.48) v1(63.09,30.76) v1(63.09,17.05) v1(63.09,3.33) v2(3.2,75.89) v2(3.2,62.17) v2(3.2,48.46) v2(3.2,34.74) v2(3.2,21.02) v2(3.2,7.31) v2(30.5,75.89) v2(30.5,62.17) v2(30.5,48.46) v2(30.5,34.74) v2(30.5,21.02) v2(30.5,7.31) v2(57.81,75.89) v2(57.81,62.17) v2(57.81,48.46) v2(57.81,34.74) v2(57.81,21.02) v2(57.81,7.31)
